# EAGLE schematic Resistor_Resistor (EAGLE 8.3.0), part 14 of 43
## Parts (continued)
R18758  10K  RESISTOR_0201  [0201]
R18759  10K  RESISTOR_0201  [0201]
R18760  10K  RESISTOR_0201  [0201]
R18761  10K  RESISTOR_0201  [0201]
R18762  10K  RESISTOR_0201  [0201]
R18763  10K  RESISTOR_0201  [0201]
R18764  10K  RESISTOR_0201  [0201]
R18765  10K  RESISTOR_0201  [0201]
R18766  10K  RESISTOR_0201  [0201]
R18767  10K  RESISTOR_0201  [0201]
R18768  10K  RESISTOR_0201  [0201]
R18769  10K  RESISTOR_0201  [0201]
R18770  10K  RESISTOR_0201  [0201]
R18771  10K  RESISTOR_0201  [0201]
R18772  10K  RESISTOR_0201  [0201]
R18773  10K  RESISTOR_0201  [0201]
R18774  10K  RESISTOR_0201  [0201]
R18775  10K  RESISTOR_0201  [0201]
R18776  10K  RESISTOR_0201  [0201]
R18777  10K  RESISTOR_0201  [0201]
R18778  10K  RESISTOR_0201  [0201]
R18779  10K  RESISTOR_0201  [0201]
R18780  10K  RESISTOR_0201  [0201]
R18781  10K  RESISTOR_0201  [0201]
R18782  10K  RESISTOR_0201  [0201]
R18783  10K  RESISTOR_0201  [0201]
R18784  10K  RESISTOR_0201  [0201]
R18785  10K  RESISTOR_0201  [0201]
R18786  10K  RESISTOR_0201  [0201]
R18787  10K  RESISTOR_0201  [0201]
R18788  10K  RESISTOR_0201  [0201]
R18789  10K  RESISTOR_0201  [0201]
R18790  10K  RESISTOR_0201  [0201]
R18791  10K  RESISTOR_0201  [0201]
R18792  10K  RESISTOR_0201  [0201]
R18793  10K  RESISTOR_0201  [0201]
R18794  10K  RESISTOR_0201  [0201]
R18795  10K  RESISTOR_0201  [0201]
R18796  10K  RESISTOR_0201  [0201]
R18797  10K  RESISTOR_0201  [0201]
R18798  10K  RESISTOR_0201  [0201]
R18799  10K  RESISTOR_0201  [0201]
R18800  10K  RESISTOR_0201  [0201]
R18801  10K  RESISTOR_0201  [0201]
R18802  10K  RESISTOR_0201  [0201]
R18803  10K  RESISTOR_0201  [0201]
R18804  10K  RESISTOR_0201  [0201]
R18805  10K  RESISTOR_0201  [0201]
R18806  10K  RESISTOR_0201  [0201]
R18807  10K  RESISTOR_0201  [0201]
R18808  10K  RESISTOR_0201  [0201]
R18809  10K  RESISTOR_0201  [0201]
R18810  10K  RESISTOR_0201  [0201]
R18811  10K  RESISTOR_0201  [0201]
R18812  10K  RESISTOR_0201  [0201]
R18813  10K  RESISTOR_0201  [0201]
R18814  10K  RESISTOR_0201  [0201]
R18815  10K  RESISTOR_0201  [0201]
R18816  10K  RESISTOR_0201  [0201]
R18817  10K  RESISTOR_0201  [0201]
R18818  10K  RESISTOR_0201  [0201]
R18819  10K  RESISTOR_0201  [0201]
R18820  10K  RESISTOR_0201  [0201]
R18821  10K  RESISTOR_0201  [0201]
R18822  10K  RESISTOR_0201  [0201]
R18823  10K  RESISTOR_0201  [0201]
R18824  10K  RESISTOR_0201  [0201]
R18825  10K  RESISTOR_0201  [0201]
R18826  10K  RESISTOR_0201  [0201]
R18827  10K  RESISTOR_0201  [0201]
R18828  10K  RESISTOR_0201  [0201]
R18829  10K  RESISTOR_0201  [0201]
R18830  10K  RESISTOR_0201  [0201]
R18831  10K  RESISTOR_0201  [0201]
R18832  10K  RESISTOR_0201  [0201]
R18833  10K  RESISTOR_0201  [0201]
R18834  10K  RESISTOR_0201  [0201]
R18835  10K  RESISTOR_0201  [0201]
R18836  10K  RESISTOR_0201  [0201]
R18837  10K  RESISTOR_0201  [0201]
R18838  10K  RESISTOR_0201  [0201]
R18839  10K  RESISTOR_0201  [0201]
R18840  10K  RESISTOR_0201  [0201]
R18841  10K  RESISTOR_0201  [0201]
R18842  10K  RESISTOR_0201  [0201]
R18843  10K  RESISTOR_0201  [0201]
R18844  10K  RESISTOR_0201  [0201]
R18845  10K  RESISTOR_0201  [0201]
R18846  10K  RESISTOR_0201  [0201]
R18847  10K  RESISTOR_0201  [0201]
R18848  10K  RESISTOR_0201  [0201]
R18849  10K  RESISTOR_0201  [0201]
R18850  10K  RESISTOR_0201  [0201]
R18851  10K  RESISTOR_0201  [0201]
R18852  10K  RESISTOR_0201  [0201]
R18853  10K  RESISTOR_0201  [0201]
R18854  10K  RESISTOR_0201  [0201]
R18855  10K  RESISTOR_0201  [0201]
R18856  10K  RESISTOR_0201  [0201]
R18857  10K  RESISTOR_0201  [0201]
R18858  10K  RESISTOR_0201  [0201]
R18859  10K  RESISTOR_0201  [0201]
R18860  10K  RESISTOR_0201  [0201]
R18861  10K  RESISTOR_0201  [0201]
R18862  10K  RESISTOR_0201  [0201]
R18863  10K  RESISTOR_0201  [0201]
R18864  10K  RESISTOR_0201  [0201]
R18865  10K  RESISTOR_0201  [0201]
R18866  10K  RESISTOR_0201  [0201]
R18867  10K  RESISTOR_0201  [0201]
R18868  10K  RESISTOR_0201  [0201]
R18869  10K  RESISTOR_0201  [0201]
R18870  10K  RESISTOR_0201  [0201]
R18871  10K  RESISTOR_0201  [0201]
R18872  10K  RESISTOR_0201  [0201]
R18873  10K  RESISTOR_0201  [0201]
R18874  10K  RESISTOR_0201  [0201]
R18875  10K  RESISTOR_0201  [0201]
R18876  10K  RESISTOR_0201  [0201]
R18877  10K  RESISTOR_0201  [0201]
R18878  10K  RESISTOR_0201  [0201]
R18879  10K  RESISTOR_0201  [0201]
R18880  10K  RESISTOR_0201  [0201]
R18881  10K  RESISTOR_0201  [0201]
R18882  10K  RESISTOR_0201  [0201]
R18883  10K  RESISTOR_0201  [0201]
R18884  10K  RESISTOR_0201  [0201]
R18885  10K  RESISTOR_0201  [0201]
R18886  10K  RESISTOR_0201  [0201]
R18887  10K  RESISTOR_0201  [0201]
R18888  10K  RESISTOR_0201  [0201]
R18889  10K  RESISTOR_0201  [0201]
R18890  10K  RESISTOR_0201  [0201]
R18891  10K  RESISTOR_0201  [0201]
R18892  10K  RESISTOR_0201  [0201]
R18893  10K  RESISTOR_0201  [0201]
R18894  10K  RESISTOR_0201  [0201]
R18895  10K  RESISTOR_0201  [0201]
R18896  10K  RESISTOR_0201  [0201]
R18897  10K  RESISTOR_0201  [0201]
R18898  10K  RESISTOR_0201  [0201]
R18899  10K  RESISTOR_0201  [0201]
R18900  10K  RESISTOR_0201  [0201]
R18901  10K  RESISTOR_0201  [0201]
R18902  10K  RESISTOR_0201  [0201]
R18903  10K  RESISTOR_0201  [0201]
R18904  10K  RESISTOR_0201  [0201]
R18905  10K  RESISTOR_0201  [0201]
R18906  10K  RESISTOR_0201  [0201]
R18907  10K  RESISTOR_0201  [0201]
R18908  10K  RESISTOR_0201  [0201]
R18909  10K  RESISTOR_0201  [0201]
R18910  10K  RESISTOR_0201  [0201]
R18911  10K  RESISTOR_0201  [0201]
R18912  10K  RESISTOR_0201  [0201]
R18913  10K  RESISTOR_0201  [0201]
R18914  10K  RESISTOR_0201  [0201]
R18915  10K  RESISTOR_0201  [0201]
R18916  10K  RESISTOR_0201  [0201]
R18917  10K  RESISTOR_0201  [0201]
R18918  10K  RESISTOR_0201  [0201]
R18919  10K  RESISTOR_0201  [0201]
R18920  10K  RESISTOR_0201  [0201]
R18921  10K  RESISTOR_0201  [0201]
R18922  10K  RESISTOR_0201  [0201]
R18923  10K  RESISTOR_0201  [0201]
R18924  10K  RESISTOR_0201  [0201]
R18925  10K  RESISTOR_0201  [0201]
R18926  10K  RESISTOR_0201  [0201]
R18927  10K  RESISTOR_0201  [0201]
R18928  10K  RESISTOR_0201  [0201]
R18929  10K  RESISTOR_0201  [0201]
R18930  10K  RESISTOR_0201  [0201]
R18931  10K  RESISTOR_0201  [0201]
R18932  10K  RESISTOR_0201  [0201]
R18933  10K  RESISTOR_0201  [0201]
R18934  10K  RESISTOR_0201  [0201]
R18935  10K  RESISTOR_0201  [0201]
R18936  10K  RESISTOR_0201  [0201]
R18937  10K  RESISTOR_0201  [0201]
R18938  10K  RESISTOR_0201  [0201]
R18939  10K  RESISTOR_0201  [0201]
R18940  10K  RESISTOR_0201  [0201]
R18941  10K  RESISTOR_0201  [0201]
R18942  10K  RESISTOR_0201  [0201]
R18943  10K  RESISTOR_0201  [0201]
R18944  10K  RESISTOR_0201  [0201]
R18945  10K  RESISTOR_0201  [0201]
R18946  10K  RESISTOR_0201  [0201]
R18947  10K  RESISTOR_0201  [0201]
R18948  10K  RESISTOR_0201  [0201]
R18949  10K  RESISTOR_0201  [0201]
R18950  10K  RESISTOR_0201  [0201]
R18951  10K  RESISTOR_0201  [0201]
R18952  10K  RESISTOR_0201  [0201]
R18953  10K  RESISTOR_0201  [0201]
R18954  10K  RESISTOR_0201  [0201]
R18955  10K  RESISTOR_0201  [0201]
R18956  10K  RESISTOR_0201  [0201]
R18957  10K  RESISTOR_0201  [0201]
R18958  10K  RESISTOR_0201  [0201]
R18959  10K  RESISTOR_0201  [0201]
R18960  10K  RESISTOR_0201  [0201]
R18961  10K  RESISTOR_0201  [0201]
R18962  10K  RESISTOR_0201  [0201]
R18963  10K  RESISTOR_0201  [0201]
R18964  10K  RESISTOR_0201  [0201]
R18965  10K  RESISTOR_0201  [0201]
R18966  10K  RESISTOR_0201  [0201]
R18967  10K  RESISTOR_0201  [0201]
R18968  10K  RESISTOR_0201  [0201]
R18969  10K  RESISTOR_0201  [0201]
R18970  10K  RESISTOR_0201  [0201]
R18971  10K  RESISTOR_0201  [0201]
R18972  10K  RESISTOR_0201  [0201]
R18973  10K  RESISTOR_0201  [0201]
R18974  10K  RESISTOR_0201  [0201]
R18975  10K  RESISTOR_0201  [0201]
R18976  10K  RESISTOR_0201  [0201]
R18977  10K  RESISTOR_0201  [0201]
R18978  10K  RESISTOR_0201  [0201]
R18979  10K  RESISTOR_0201  [0201]
R18980  10K  RESISTOR_0201  [0201]
R18981  10K  RESISTOR_0201  [0201]
R18982  10K  RESISTOR_0201  [0201]
R18983  10K  RESISTOR_0201  [0201]
R18984  10K  RESISTOR_0201  [0201]
R18985  10K  RESISTOR_0201  [0201]
R18986  10K  RESISTOR_0201  [0201]
R18987  10K  RESISTOR_0201  [0201]
R18988  10K  RESISTOR_0201  [0201]
R18989  10K  RESISTOR_0201  [0201]
R18990  10K  RESISTOR_0201  [0201]
R18991  10K  RESISTOR_0201  [0201]
R18992  10K  RESISTOR_0201  [0201]
R18993  10K  RESISTOR_0201  [0201]
R18994  10K  RESISTOR_0201  [0201]
R18995  10K  RESISTOR_0201  [0201]
R18996  10K  RESISTOR_0201  [0201]
R18997  10K  RESISTOR_0201  [0201]
R18998  10K  RESISTOR_0201  [0201]
R18999  10K  RESISTOR_0201  [0201]
R19000  10K  RESISTOR_0201  [0201]
R19001  10K  RESISTOR_0201  [0201]
R19002  10K  RESISTOR_0201  [0201]
R19003  10K  RESISTOR_0201  [0201]
R19004  10K  RESISTOR_0201  [0201]
R19005  10K  RESISTOR_0201  [0201]
R19006  10K  RESISTOR_0201  [0201]
R19007  10K  RESISTOR_0201  [0201]
R19008  10K  RESISTOR_0201  [0201]
R19009  10K  RESISTOR_0201  [0201]
R19010  10K  RESISTOR_0201  [0201]
R19011  10K  RESISTOR_0201  [0201]
R19012  10K  RESISTOR_0201  [0201]
R19013  10K  RESISTOR_0201  [0201]
R19014  10K  RESISTOR_0201  [0201]
R19015  10K  RESISTOR_0201  [0201]
R19016  10K  RESISTOR_0201  [0201]
R19017  10K  RESISTOR_0201  [0201]
R19018  10K  RESISTOR_0201  [0201]
R19019  10K  RESISTOR_0201  [0201]
R19020  10K  RESISTOR_0201  [0201]
R19021  10K  RESISTOR_0201  [0201]
R19022  10K  RESISTOR_0201  [0201]
R19023  10K  RESISTOR_0201  [0201]
R19024  10K  RESISTOR_0201  [0201]
R19025  10K  RESISTOR_0201  [0201]
R19026  10K  RESISTOR_0201  [0201]
R19027  10K  RESISTOR_0201  [0201]
R19028  10K  RESISTOR_0201  [0201]
R19029  10K  RESISTOR_0201  [0201]
R19030  10K  RESISTOR_0201  [0201]
R19031  10K  RESISTOR_0201  [0201]
R19032  10K  RESISTOR_0201  [0201]
R19033  10K  RESISTOR_0201  [0201]
R19034  10K  RESISTOR_0201  [0201]
R19035  10K  RESISTOR_0201  [0201]
R19036  10K  RESISTOR_0201  [0201]
R19037  10K  RESISTOR_0201  [0201]
R19038  10K  RESISTOR_0201  [0201]
R19039  10K  RESISTOR_0201  [0201]
R19040  10K  RESISTOR_0201  [0201]
R19041  10K  RESISTOR_0201  [0201]
R19042  10K  RESISTOR_0201  [0201]
R19043  10K  RESISTOR_0201  [0201]
R19044  10K  RESISTOR_0201  [0201]
R19045  10K  RESISTOR_0201  [0201]
R19046  10K  RESISTOR_0201  [0201]
R19047  10K  RESISTOR_0201  [0201]
R19048  10K  RESISTOR_0201  [0201]
R19049  10K  RESISTOR_0201  [0201]
R19050  10K  RESISTOR_0201  [0201]
R19051  10K  RESISTOR_0201  [0201]
R19052  10K  RESISTOR_0201  [0201]
R19053  10K  RESISTOR_0201  [0201]
R19054  10K  RESISTOR_0201  [0201]
R19055  10K  RESISTOR_0201  [0201]
R19056  10K  RESISTOR_0201  [0201]
R19057  10K  RESISTOR_0201  [0201]
R19058  10K  RESISTOR_0201  [0201]
R19059  10K  RESISTOR_0201  [0201]
R19060  10K  RESISTOR_0201  [0201]
R19061  10K  RESISTOR_0201  [0201]
R19062  10K  RESISTOR_0201  [0201]
R19063  10K  RESISTOR_0201  [0201]
R19064  10K  RESISTOR_0201  [0201]
R19065  10K  RESISTOR_0201  [0201]
R19066  10K  RESISTOR_0201  [0201]
R19067  10K  RESISTOR_0201  [0201]
R19068  10K  RESISTOR_0201  [0201]
R19069  10K  RESISTOR_0201  [0201]
R19070  10K  RESISTOR_0201  [0201]
R19071  10K  RESISTOR_0201  [0201]
R19072  10K  RESISTOR_0201  [0201]
R19073  10K  RESISTOR_0201  [0201]
R19074  10K  RESISTOR_0201  [0201]
R19075  10K  RESISTOR_0201  [0201]
R19076  10K  RESISTOR_0201  [0201]
R19077  10K  RESISTOR_0201  [0201]
R19078  10K  RESISTOR_0201  [0201]
R19079  10K  RESISTOR_0201  [0201]
R19080  10K  RESISTOR_0201  [0201]
R19081  10K  RESISTOR_0201  [0201]
R19082  10K  RESISTOR_0201  [0201]
R19083  10K  RESISTOR_0201  [0201]
R19084  10K  RESISTOR_0201  [0201]
R19085  10K  RESISTOR_0201  [0201]
R19086  10K  RESISTOR_0201  [0201]
R19087  10K  RESISTOR_0201  [0201]
R19088  10K  RESISTOR_0201  [0201]
R19089  10K  RESISTOR_0201  [0201]
R19090  10K  RESISTOR_0201  [0201]
R19091  10K  RESISTOR_0201  [0201]
R19092  10K  RESISTOR_0201  [0201]
R19093  10K  RESISTOR_0201  [0201]
R19094  10K  RESISTOR_0201  [0201]
R19095  10K  RESISTOR_0201  [0201]
R19096  10K  RESISTOR_0201  [0201]
R19097  10K  RESISTOR_0201  [0201]
R19098  10K  RESISTOR_0201  [0201]
R19099  10K  RESISTOR_0201  [0201]
R19100  10K  RESISTOR_0201  [0201]
R19101  10K  RESISTOR_0201  [0201]
R19102  10K  RESISTOR_0201  [0201]
R19103  10K  RESISTOR_0201  [0201]
R19104  10K  RESISTOR_0201  [0201]
R19105  10K  RESISTOR_0201  [0201]
R19106  10K  RESISTOR_0201  [0201]
R19107  10K  RESISTOR_0201  [0201]
R19108  10K  RESISTOR_0201  [0201]
R19109  10K  RESISTOR_0201  [0201]
R19110  10K  RESISTOR_0201  [0201]
R19111  10K  RESISTOR_0201  [0201]
R19112  10K  RESISTOR_0201  [0201]
R19113  10K  RESISTOR_0201  [0201]
R19114  10K  RESISTOR_0201  [0201]
R19115  10K  RESISTOR_0201  [0201]
R19116  10K  RESISTOR_0201  [0201]
R19117  10K  RESISTOR_0201  [0201]
R19118  10K  RESISTOR_0201  [0201]
R19119  10K  RESISTOR_0201  [0201]
R19120  10K  RESISTOR_0201  [0201]
R19121  10K  RESISTOR_0201  [0201]
R19122  10K  RESISTOR_0201  [0201]
R19123  10K  RESISTOR_0201  [0201]
R19124  10K  RESISTOR_0201  [0201]
R19125  10K  RESISTOR_0201  [0201]
R19126  10K  RESISTOR_0201  [0201]
R19127  10K  RESISTOR_0201  [0201]
R19128  10K  RESISTOR_0201  [0201]
R19129  10K  RESISTOR_0201  [0201]
R19130  10K  RESISTOR_0201  [0201]
R19131  10K  RESISTOR_0201  [0201]
R19132  10K  RESISTOR_0201  [0201]
R19133  10K  RESISTOR_0201  [0201]
R19134  10K  RESISTOR_0201  [0201]
R19135  10K  RESISTOR_0201  [0201]
R19136  10K  RESISTOR_0201  [0201]
R19137  10K  RESISTOR_0201  [0201]
R19138  10K  RESISTOR_0201  [0201]
R19139  10K  RESISTOR_0201  [0201]
R19140  10K  RESISTOR_0201  [0201]
R19141  10K  RESISTOR_0201  [0201]
R19142  10K  RESISTOR_0201  [0201]
R19143  10K  RESISTOR_0201  [0201]
R19144  10K  RESISTOR_0201  [0201]
R19145  10K  RESISTOR_0201  [0201]
R19146  10K  RESISTOR_0201  [0201]
R19147  10K  RESISTOR_0201  [0201]
R19148  10K  RESISTOR_0201  [0201]
R19149  10K  RESISTOR_0201  [0201]
R19150  10K  RESISTOR_0201  [0201]
R19151  10K  RESISTOR_0201  [0201]
R19152  10K  RESISTOR_0201  [0201]
R19153  10K  RESISTOR_0201  [0201]
R19154  10K  RESISTOR_0201  [0201]
R19155  10K  RESISTOR_0201  [0201]
R19156  10K  RESISTOR_0201  [0201]
R19157  10K  RESISTOR_0201  [0201]
R19158  10K  RESISTOR_0201  [0201]
R19159  10K  RESISTOR_0201  [0201]
R19160  10K  RESISTOR_0201  [0201]
R19161  10K  RESISTOR_0201  [0201]
R19162  10K  RESISTOR_0201  [0201]
R19163  10K  RESISTOR_0201  [0201]
R19164  10K  RESISTOR_0201  [0201]
R19165  10K  RESISTOR_0201  [0201]
R19166  10K  RESISTOR_0201  [0201]
R19167  10K  RESISTOR_0201  [0201]
R19168  10K  RESISTOR_0201  [0201]
R19169  10K  RESISTOR_0201  [0201]
R19170  10K  RESISTOR_0201  [0201]
R19171  10K  RESISTOR_0201  [0201]
R19172  10K  RESISTOR_0201  [0201]
R19173  10K  RESISTOR_0201  [0201]
R19174  10K  RESISTOR_0201  [0201]
R19175  10K  RESISTOR_0201  [0201]
R19176  10K  RESISTOR_0201  [0201]
R19177  10K  RESISTOR_0201  [0201]
R19178  10K  RESISTOR_0201  [0201]
R19179  10K  RESISTOR_0201  [0201]
R19180  10K  RESISTOR_0201  [0201]
R19181  10K  RESISTOR_0201  [0201]
R19182  10K  RESISTOR_0201  [0201]
R19183  10K  RESISTOR_0201  [0201]
R19184  10K  RESISTOR_0201  [0201]
R19185  10K  RESISTOR_0201  [0201]
R19186  10K  RESISTOR_0201  [0201]
R19187  10K  RESISTOR_0201  [0201]
R19188  10K  RESISTOR_0201  [0201]
R19189  10K  RESISTOR_0201  [0201]
R19190  10K  RESISTOR_0201  [0201]
R19191  10K  RESISTOR_0201  [0201]
R19192  10K  RESISTOR_0201  [0201]
R19193  10K  RESISTOR_0201  [0201]
R19194  10K  RESISTOR_0201  [0201]
R19195  10K  RESISTOR_0201  [0201]
R19196  10K  RESISTOR_0201  [0201]
R19197  10K  RESISTOR_0201  [0201]
R19198  10K  RESISTOR_0201  [0201]
R19199  10K  RESISTOR_0201  [0201]
R19200  10K  RESISTOR_0201  [0201]
R19201  10K  RESISTOR_0201  [0201]
R19202  10K  RESISTOR_0201  [0201]
R19203  10K  RESISTOR_0201  [0201]
R19204  10K  RESISTOR_0201  [0201]
R19205  10K  RESISTOR_0201  [0201]
R19206  10K  RESISTOR_0201  [0201]
R19207  10K  RESISTOR_0201  [0201]
R19208  10K  RESISTOR_0201  [0201]
R19209  10K  RESISTOR_0201  [0201]
R19210  10K  RESISTOR_0201  [0201]
R19211  10K  RESISTOR_0201  [0201]
R19212  10K  RESISTOR_0201  [0201]
R19213  10K  RESISTOR_0201  [0201]
R19214  10K  RESISTOR_0201  [0201]
R19215  10K  RESISTOR_0201  [0201]
R19216  10K  RESISTOR_0201  [0201]
R19217  10K  RESISTOR_0201  [0201]
R19218  10K  RESISTOR_0201  [0201]
R19219  10K  RESISTOR_0201  [0201]
R19220  10K  RESISTOR_0201  [0201]
R19221  10K  RESISTOR_0201  [0201]
R19222  10K  RESISTOR_0201  [0201]
R19223  10K  RESISTOR_0201  [0201]
R19224  10K  RESISTOR_0201  [0201]
R19225  10K  RESISTOR_0201  [0201]
R19226  10K  RESISTOR_0201  [0201]
R19227  10K  RESISTOR_0201  [0201]
R19228  10K  RESISTOR_0201  [0201]
R19229  10K  RESISTOR_0201  [0201]
R19230  10K  RESISTOR_0201  [0201]
R19231  10K  RESISTOR_0201  [0201]
R19232  10K  RESISTOR_0201  [0201]
R19233  10K  RESISTOR_0201  [0201]
R19234  10K  RESISTOR_0201  [0201]
R19235  10K  RESISTOR_0201  [0201]
R19236  10K  RESISTOR_0201  [0201]
R19237  10K  RESISTOR_0201  [0201]
R19238  10K  RESISTOR_0201  [0201]
R19239  10K  RESISTOR_0201  [0201]
R19240  10K  RESISTOR_0201  [0201]
R19241  10K  RESISTOR_0201  [0201]
R19242  10K  RESISTOR_0201  [0201]
R19243  10K  RESISTOR_0201  [0201]
R19244  10K  RESISTOR_0201  [0201]
R19245  10K  RESISTOR_0201  [0201]
R19246  10K  RESISTOR_0201  [0201]
R19247  10K  RESISTOR_0201  [0201]
R19248  10K  RESISTOR_0201  [0201]
R19249  10K  RESISTOR_0201  [0201]
R19250  10K  RESISTOR_0201  [0201]
R19251  10K  RESISTOR_0201  [0201]
R19252  10K  RESISTOR_0201  [0201]
R19253  10K  RESISTOR_0201  [0201]
R19254  10K  RESISTOR_0201  [0201]
R19255  10K  RESISTOR_0201  [0201]
R19256  10K  RESISTOR_0201  [0201]
R19257  10K  RESISTOR_0201  [0201]
R19258  10K  RESISTOR_0201  [0201]
R19259  10K  RESISTOR_0201  [0201]
R19260  10K  RESISTOR_0201  [0201]
R19261  10K  RESISTOR_0201  [0201]
R19262  10K  RESISTOR_0201  [0201]
R19263  10K  RESISTOR_0201  [0201]
R19264  10K  RESISTOR_0201  [0201]
R19265  10K  RESISTOR_0201  [0201]
R19266  10K  RESISTOR_0201  [0201]
R19267  10K  RESISTOR_0201  [0201]
R19268  10K  RESISTOR_0201  [0201]
R19269  10K  RESISTOR_0201  [0201]
R19270  10K  RESISTOR_0201  [0201]
R19271  10K  RESISTOR_0201  [0201]
R19272  10K  RESISTOR_0201  [0201]
R19273  10K  RESISTOR_0201  [0201]
R19274  10K  RESISTOR_0201  [0201]
R19275  10K  RESISTOR_0201  [0201]
R19276  10K  RESISTOR_0201  [0201]
R19277  10K  RESISTOR_0201  [0201]
R19278  10K  RESISTOR_0201  [0201]
R19279  10K  RESISTOR_0201  [0201]
R19280  10K  RESISTOR_0201  [0201]
R19281  10K  RESISTOR_0201  [0201]
R19282  10K  RESISTOR_0201  [0201]
R19283  10K  RESISTOR_0201  [0201]
R19284  10K  RESISTOR_0201  [0201]
R19285  10K  RESISTOR_0201  [0201]
R19286  10K  RESISTOR_0201  [0201]
R19287  10K  RESISTOR_0201  [0201]
R19288  10K  RESISTOR_0201  [0201]
R19289  10K  RESISTOR_0201  [0201]
R19290  10K  RESISTOR_0201  [0201]
R19291  10K  RESISTOR_0201  [0201]
R19292  10K  RESISTOR_0201  [0201]
R19293  10K  RESISTOR_0201  [0201]
R19294  10K  RESISTOR_0201  [0201]
R19295  10K  RESISTOR_0201  [0201]
R19296  10K  RESISTOR_0201  [0201]
R19297  10K  RESISTOR_0201  [0201]
R19298  10K  RESISTOR_0201  [0201]
R19299  10K  RESISTOR_0201  [0201]
R19300  10K  RESISTOR_0201  [0201]
R19301  10K  RESISTOR_0201  [0201]
R19302  10K  RESISTOR_0201  [0201]
R19303  10K  RESISTOR_0201  [0201]
R19304  10K  RESISTOR_0201  [0201]
R19305  10K  RESISTOR_0201  [0201]
R19306  10K  RESISTOR_0201  [0201]
R19307  10K  RESISTOR_0201  [0201]
R19308  10K  RESISTOR_0201  [0201]
R19309  10K  RESISTOR_0201  [0201]
R19310  10K  RESISTOR_0201  [0201]
R19311  10K  RESISTOR_0201  [0201]
R19312  10K  RESISTOR_0201  [0201]
R19313  10K  RESISTOR_0201  [0201]
R19314  10K  RESISTOR_0201  [0201]
R19315  10K  RESISTOR_0201  [0201]
R19316  10K  RESISTOR_0201  [0201]
R19317  10K  RESISTOR_0201  [0201]
R19318  10K  RESISTOR_0201  [0201]
R19319  10K  RESISTOR_0201  [0201]
R19320  10K  RESISTOR_0201  [0201]
R19321  10K  RESISTOR_0201  [0201]
R19322  10K  RESISTOR_0201  [0201]
R19323  10K  RESISTOR_0201  [0201]
R19324  10K  RESISTOR_0201  [0201]
R19325  10K  RESISTOR_0201  [0201]
R19326  10K  RESISTOR_0201  [0201]
R19327  10K  RESISTOR_0201  [0201]
R19328  10K  RESISTOR_0201  [0201]
R19329  10K  RESISTOR_0201  [0201]
R19330  10K  RESISTOR_0201  [0201]
R19331  10K  RESISTOR_0201  [0201]
R19332  10K  RESISTOR_0201  [0201]
R19333  10K  RESISTOR_0201  [0201]
R19334  10K  RESISTOR_0201  [0201]
R19335  10K  RESISTOR_0201  [0201]
R19336  10K  RESISTOR_0201  [0201]
R19337  10K  RESISTOR_0201  [0201]
R19338  10K  RESISTOR_0201  [0201]
R19339  10K  RESISTOR_0201  [0201]
R19340  10K  RESISTOR_0201  [0201]
R19341  10K  RESISTOR_0201  [0201]
R19342  10K  RESISTOR_0201  [0201]
R19343  10K  RESISTOR_0201  [0201]
R19344  10K  RESISTOR_0201  [0201]
R19345  10K  RESISTOR_0201  [0201]
R19346  10K  RESISTOR_0201  [0201]
R19347  10K  RESISTOR_0201  [0201]
R19348  10K  RESISTOR_0201  [0201]
R19349  10K  RESISTOR_0201  [0201]
R19350  10K  RESISTOR_0201  [0201]
R19351  10K  RESISTOR_0201  [0201]
R19352  10K  RESISTOR_0201  [0201]
R19353  10K  RESISTOR_0201  [0201]
R19354  10K  RESISTOR_0201  [0201]
R19355  10K  RESISTOR_0201  [0201]
R19356  10K  RESISTOR_0201  [0201]
R19357  10K  RESISTOR_0201  [0201]
R19358  10K  RESISTOR_0201  [0201]
R19359  10K  RESISTOR_0201  [0201]
R19360  10K  RESISTOR_0201  [0201]
R19361  10K  RESISTOR_0201  [0201]
R19362  10K  RESISTOR_0201  [0201]
R19363  10K  RESISTOR_0201  [0201]
R19364  10K  RESISTOR_0201  [0201]
R19365  10K  RESISTOR_0201  [0201]
R19366  10K  RESISTOR_0201  [0201]
R19367  10K  RESISTOR_0201  [0201]
R19368  10K  RESISTOR_0201  [0201]
R19369  10K  RESISTOR_0201  [0201]
R19370  10K  RESISTOR_0201  [0201]
R19371  10K  RESISTOR_0201  [0201]
R19372  10K  RESISTOR_0201  [0201]
R19373  10K  RESISTOR_0201  [0201]
R19374  10K  RESISTOR_0201  [0201]
R19375  10K  RESISTOR_0201  [0201]
R19376  10K  RESISTOR_0201  [0201]
R19377  10K  RESISTOR_0201  [0201]
R19378  10K  RESISTOR_0201  [0201]
R19379  10K  RESISTOR_0201  [0201]
R19380  10K  RESISTOR_0201  [0201]
R19381  10K  RESISTOR_0201  [0201]
R19382  10K  RESISTOR_0201  [0201]
R19383  10K  RESISTOR_0201  [0201]
R19384  10K  RESISTOR_0201  [0201]
R19385  10K  RESISTOR_0201  [0201]
R19386  10K  RESISTOR_0201  [0201]
R19387  10K  RESISTOR_0201  [0201]
R19388  10K  RESISTOR_0201  [0201]
R19389  10K  RESISTOR_0201  [0201]
R19390  10K  RESISTOR_0201  [0201]
R19391  10K  RESISTOR_0201  [0201]
R19392  10K  RESISTOR_0201  [0201]
R19393  10K  RESISTOR_0201  [0201]
R19394  10K  RESISTOR_0201  [0201]
R19395  10K  RESISTOR_0201  [0201]
R19396  10K  RESISTOR_0201  [0201]
R19397  10K  RESISTOR_0201  [0201]
R19398  10K  RESISTOR_0201  [0201]
R19399  10K  RESISTOR_0201  [0201]
R19400  10K  RESISTOR_0201  [0201]
R19401  10K  RESISTOR_0201  [0201]
R19402  10K  RESISTOR_0201  [0201]
R19403  10K  RESISTOR_0201  [0201]
R19404  10K  RESISTOR_0201  [0201]
R19405  10K  RESISTOR_0201  [0201]
R19406  10K  RESISTOR_0201  [0201]
R19407  10K  RESISTOR_0201  [0201]
R19408  10K  RESISTOR_0201  [0201]
R19409  10K  RESISTOR_0201  [0201]
R19410  10K  RESISTOR_0201  [0201]
R19411  10K  RESISTOR_0201  [0201]
R19412  10K  RESISTOR_0201  [0201]
R19413  10K  RESISTOR_0201  [0201]
R19414  10K  RESISTOR_0201  [0201]
R19415  10K  RESISTOR_0201  [0201]
R19416  10K  RESISTOR_0201  [0201]
R19417  10K  RESISTOR_0201  [0201]
R19418  10K  RESISTOR_0201  [0201]
R19419  10K  RESISTOR_0201  [0201]
R19420  10K  RESISTOR_0201  [0201]
R19421  10K  RESISTOR_0201  [0201]
R19422  10K  RESISTOR_0201  [0201]
R19423  10K  RESISTOR_0201  [0201]
R19424  10K  RESISTOR_0201  [0201]
R19425  10K  RESISTOR_0201  [0201]
R19426  10K  RESISTOR_0201  [0201]
R19427  10K  RESISTOR_0201  [0201]
R19428  10K  RESISTOR_0201  [0201]
R19429  10K  RESISTOR_0201  [0201]
R19430  10K  RESISTOR_0201  [0201]
R19431  10K  RESISTOR_0201  [0201]
R19432  10K  RESISTOR_0201  [0201]
R19433  10K  RESISTOR_0201  [0201]
R19434  10K  RESISTOR_0201  [0201]
R19435  10K  RESISTOR_0201  [0201]
R19436  10K  RESISTOR_0201  [0201]
R19437  10K  RESISTOR_0201  [0201]
R19438  10K  RESISTOR_0201  [0201]
R19439  10K  RESISTOR_0201  [0201]
R19440  10K  RESISTOR_0201  [0201]
R19441  10K  RESISTOR_0201  [0201]
R19442  10K  RESISTOR_0201  [0201]
R19443  10K  RESISTOR_0201  [0201]
R19444  10K  RESISTOR_0201  [0201]
R19445  10K  RESISTOR_0201  [0201]
R19446  10K  RESISTOR_0201  [0201]
R19447  10K  RESISTOR_0201  [0201]
R19448  10K  RESISTOR_0201  [0201]
R19449  10K  RESISTOR_0201  [0201]
R19450  10K  RESISTOR_0201  [0201]
R19451  10K  RESISTOR_0201  [0201]
R19452  10K  RESISTOR_0201  [0201]
R19453  10K  RESISTOR_0201  [0201]
R19454  10K  RESISTOR_0201  [0201]
R19455  10K  RESISTOR_0201  [0201]
R19456  10K  RESISTOR_0201  [0201]
R19457  10K  RESISTOR_0201  [0201]
R19458  10K  RESISTOR_0201  [0201]
R19459  10K  RESISTOR_0201  [0201]
R19460  10K  RESISTOR_0201  [0201]
R19461  10K  RESISTOR_0201  [0201]
R19462  10K  RESISTOR_0201  [0201]
R19463  10K  RESISTOR_0201  [0201]
R19464  10K  RESISTOR_0201  [0201]
R19465  10K  RESISTOR_0201  [0201]
R19466  10K  RESISTOR_0201  [0201]
R19467  10K  RESISTOR_0201  [0201]
R19468  10K  RESISTOR_0201  [0201]
R19469  10K  RESISTOR_0201  [0201]
R19470  10K  RESISTOR_0201  [0201]
R19471  10K  RESISTOR_0201  [0201]
R19472  10K  RESISTOR_0201  [0201]
R19473  10K  RESISTOR_0201  [0201]
R19474  10K  RESISTOR_0201  [0201]
R19475  10K  RESISTOR_0201  [0201]
R19476  10K  RESISTOR_0201  [0201]
R19477  10K  RESISTOR_0201  [0201]
R19478  10K  RESISTOR_0201  [0201]
R19479  10K  RESISTOR_0201  [0201]
R19480  10K  RESISTOR_0201  [0201]
R19481  10K  RESISTOR_0201  [0201]
R19482  10K  RESISTOR_0201  [0201]
R19483  10K  RESISTOR_0201  [0201]
R19484  10K  RESISTOR_0201  [0201]
R19485  10K  RESISTOR_0201  [0201]
R19486  10K  RESISTOR_0201  [0201]
R19487  10K  RESISTOR_0201  [0201]
R19488  10K  RESISTOR_0201  [0201]
R19489  10K  RESISTOR_0201  [0201]
R19490  10K  RESISTOR_0201  [0201]
R19491  10K  RESISTOR_0201  [0201]
R19492  10K  RESISTOR_0201  [0201]
R19493  10K  RESISTOR_0201  [0201]
R19494  10K  RESISTOR_0201  [0201]
R19495  10K  RESISTOR_0201  [0201]
R19496  10K  RESISTOR_0201  [0201]
R19497  10K  RESISTOR_0201  [0201]
R19498  10K  RESISTOR_0201  [0201]
R19499  10K  RESISTOR_0201  [0201]
R19500  10K  RESISTOR_0201  [0201]
R19501  10K  RESISTOR_0201  [0201]
R19502  10K  RESISTOR_0201  [0201]
R19503  10K  RESISTOR_0201  [0201]
R19504  10K  RESISTOR_0201  [0201]
R19505  10K  RESISTOR_0201  [0201]
R19506  10K  RESISTOR_0201  [0201]
R19507  10K  RESISTOR_0201  [0201]
R19508  10K  RESISTOR_0201  [0201]
R19509  10K  RESISTOR_0201  [0201]
R19510  10K  RESISTOR_0201  [0201]
R19511  10K  RESISTOR_0201  [0201]
R19512  10K  RESISTOR_0201  [0201]
R19513  10K  RESISTOR_0201  [0201]
R19514  10K  RESISTOR_0201  [0201]
R19515  10K  RESISTOR_0201  [0201]
R19516  10K  RESISTOR_0201  [0201]
R19517  10K  RESISTOR_0201  [0201]
R19518  10K  RESISTOR_0201  [0201]
R19519  10K  RESISTOR_0201  [0201]
R19520  10K  RESISTOR_0201  [0201]
R19521  10K  RESISTOR_0201  [0201]
R19522  10K  RESISTOR_0201  [0201]
R19523  10K  RESISTOR_0201  [0201]
R19524  10K  RESISTOR_0201  [0201]
R19525  10K  RESISTOR_0201  [0201]
R19526  10K  RESISTOR_0201  [0201]
R19527  10K  RESISTOR_0201  [0201]
R19528  10K  RESISTOR_0201  [0201]
R19529  10K  RESISTOR_0201  [0201]
R19530  10K  RESISTOR_0201  [0201]
R19531  10K  RESISTOR_0201  [0201]
R19532  10K  RESISTOR_0201  [0201]
R19533  10K  RESISTOR_0201  [0201]
R19534  10K  RESISTOR_0201  [0201]
R19535  10K  RESISTOR_0201  [0201]
R19536  10K  RESISTOR_0201  [0201]
R19537  10K  RESISTOR_0201  [0201]
R19538  10K  RESISTOR_0201  [0201]
R19539  10K  RESISTOR_0201  [0201]
R19540  10K  RESISTOR_0201  [0201]
R19541  10K  RESISTOR_0201  [0201]
R19542  10K  RESISTOR_0201  [0201]
R19543  10K  RESISTOR_0201  [0201]
R19544  10K  RESISTOR_0201  [0201]
R19545  10K  RESISTOR_0201  [0201]
R19546  10K  RESISTOR_0201  [0201]
R19547  10K  RESISTOR_0201  [0201]
R19548  10K  RESISTOR_0201  [0201]
R19549  10K  RESISTOR_0201  [0201]
R19550  10K  RESISTOR_0201  [0201]
R19551  10K  RESISTOR_0201  [0201]
R19552  10K  RESISTOR_0201  [0201]
R19553  10K  RESISTOR_0201  [0201]
R19554  10K  RESISTOR_0201  [0201]
R19555  10K  RESISTOR_0201  [0201]
R19556  10K  RESISTOR_0201  [0201]
R19557  10K  RESISTOR_0201  [0201]
R19558  10K  RESISTOR_0201  [0201]
R19559  10K  RESISTOR_0201  [0201]
R19560  10K  RESISTOR_0201  [0201]
R19561  10K  RESISTOR_0201  [0201]
R19562  10K  RESISTOR_0201  [0201]
R19563  10K  RESISTOR_0201  [0201]
R19564  10K  RESISTOR_0201  [0201]
R19565  10K  RESISTOR_0201  [0201]
R19566  10K  RESISTOR_0201  [0201]
R19567  10K  RESISTOR_0201  [0201]
R19568  10K  RESISTOR_0201  [0201]
R19569  10K  RESISTOR_0201  [0201]
R19570  10K  RESISTOR_0201  [0201]
R19571  10K  RESISTOR_0201  [0201]
R19572  10K  RESISTOR_0201  [0201]
R19573  10K  RESISTOR_0201  [0201]
R19574  10K  RESISTOR_0201  [0201]
R19575  10K  RESISTOR_0201  [0201]
R19576  10K  RESISTOR_0201  [0201]
R19577  10K  RESISTOR_0201  [0201]
R19578  10K  RESISTOR_0201  [0201]
R19579  10K  RESISTOR_0201  [0201]
R19580  10K  RESISTOR_0201  [0201]
R19581  10K  RESISTOR_0201  [0201]
R19582  10K  RESISTOR_0201  [0201]
R19583  10K  RESISTOR_0201  [0201]
R19584  10K  RESISTOR_0201  [0201]
R19585  10K  RESISTOR_0201  [0201]
R19586  10K  RESISTOR_0201  [0201]
R19587  10K  RESISTOR_0201  [0201]
R19588  10K  RESISTOR_0201  [0201]
R19589  10K  RESISTOR_0201  [0201]
R19590  10K  RESISTOR_0201  [0201]
R19591  10K  RESISTOR_0201  [0201]
R19592  10K  RESISTOR_0201  [0201]
R19593  10K  RESISTOR_0201  [0201]
R19594  10K  RESISTOR_0201  [0201]
R19595  10K  RESISTOR_0201  [0201]
R19596  10K  RESISTOR_0201  [0201]
R19597  10K  RESISTOR_0201  [0201]
R19598  10K  RESISTOR_0201  [0201]
R19599  10K  RESISTOR_0201  [0201]
R19600  10K  RESISTOR_0201  [0201]
R19601  10K  RESISTOR_0201  [0201]
R19602  10K  RESISTOR_0201  [0201]
R19603  10K  RESISTOR_0201  [0201]
R19604  10K  RESISTOR_0201  [0201]
R19605  10K  RESISTOR_0201  [0201]
R19606  10K  RESISTOR_0201  [0201]
R19607  10K  RESISTOR_0201  [0201]
R19608  10K  RESISTOR_0201  [0201]
R19609  10K  RESISTOR_0201  [0201]
R19610  10K  RESISTOR_0201  [0201]
R19611  10K  RESISTOR_0201  [0201]
R19612  10K  RESISTOR_0201  [0201]
R19613  10K  RESISTOR_0201  [0201]
R19614  10K  RESISTOR_0201  [0201]
R19615  10K  RESISTOR_0201  [0201]
R19616  10K  RESISTOR_0201  [0201]
R19617  10K  RESISTOR_0201  [0201]
R19618  10K  RESISTOR_0201  [0201]
R19619  10K  RESISTOR_0201  [0201]
R19620  10K  RESISTOR_0201  [0201]
R19621  10K  RESISTOR_0201  [0201]
R19622  10K  RESISTOR_0201  [0201]
R19623  10K  RESISTOR_0201  [0201]
R19624  10K  RESISTOR_0201  [0201]
R19625  10K  RESISTOR_0201  [0201]
R19626  10K  RESISTOR_0201  [0201]
R19627  10K  RESISTOR_0201  [0201]
R19628  10K  RESISTOR_0201  [0201]
R19629  10K  RESISTOR_0201  [0201]
R19630  10K  RESISTOR_0201  [0201]
R19631  10K  RESISTOR_0201  [0201]
R19632  10K  RESISTOR_0201  [0201]
R19633  10K  RESISTOR_0201  [0201]
R19634  10K  RESISTOR_0201  [0201]
R19635  10K  RESISTOR_0201  [0201]
R19636  10K  RESISTOR_0201  [0201]
R19637  10K  RESISTOR_0201  [0201]
R19638  10K  RESISTOR_0201  [0201]
R19639  10K  RESISTOR_0201  [0201]
R19640  10K  RESISTOR_0201  [0201]
R19641  10K  RESISTOR_0201  [0201]
R19642  10K  RESISTOR_0201  [0201]
R19643  10K  RESISTOR_0201  [0201]
R19644  10K  RESISTOR_0201  [0201]
R19645  10K  RESISTOR_0201  [0201]
R19646  10K  RESISTOR_0201  [0201]
R19647  10K  RESISTOR_0201  [0201]
R19648  10K  RESISTOR_0201  [0201]
R19649  10K  RESISTOR_0201  [0201]
R19650  10K  RESISTOR_0201  [0201]
R19651  10K  RESISTOR_0201  [0201]
R19652  10K  RESISTOR_0201  [0201]
R19653  10K  RESISTOR_0201  [0201]
R19654  10K  RESISTOR_0201  [0201]
R19655  10K  RESISTOR_0201  [0201]
R19656  10K  RESISTOR_0201  [0201]
R19657  10K  RESISTOR_0201  [0201]
R19658  10K  RESISTOR_0201  [0201]
R19659  10K  RESISTOR_0201  [0201]
R19660  10K  RESISTOR_0201  [0201]
R19661  10K  RESISTOR_0201  [0201]
R19662  10K  RESISTOR_0201  [0201]
R19663  10K  RESISTOR_0201  [0201]
R19664  10K  RESISTOR_0201  [0201]
R19665  10K  RESISTOR_0201  [0201]
R19666  10K  RESISTOR_0201  [0201]
R19667  10K  RESISTOR_0201  [0201]
R19668  10K  RESISTOR_0201  [0201]
R19669  10K  RESISTOR_0201  [0201]
R19670  10K  RESISTOR_0201  [0201]
R19671  10K  RESISTOR_0201  [0201]
R19672  10K  RESISTOR_0201  [0201]
R19673  10K  RESISTOR_0201  [0201]
R19674  10K  RESISTOR_0201  [0201]
R19675  10K  RESISTOR_0201  [0201]
R19676  10K  RESISTOR_0201  [0201]
R19677  10K  RESISTOR_0201  [0201]
R19678  10K  RESISTOR_0201  [0201]
R19679  10K  RESISTOR_0201  [0201]
R19680  10K  RESISTOR_0201  [0201]
R19681  10K  RESISTOR_0201  [0201]
R19682  10K  RESISTOR_0201  [0201]
R19683  10K  RESISTOR_0201  [0201]
R19684  10K  RESISTOR_0201  [0201]
R19685  10K  RESISTOR_0201  [0201]
R19686  10K  RESISTOR_0201  [0201]
R19687  10K  RESISTOR_0201  [0201]
R19688  10K  RESISTOR_0201  [0201]
R19689  10K  RESISTOR_0201  [0201]
R19690  10K  RESISTOR_0201  [0201]
R19691  10K  RESISTOR_0201  [0201]
R19692  10K  RESISTOR_0201  [0201]
R19693  10K  RESISTOR_0201  [0201]
R19694  10K  RESISTOR_0201  [0201]
R19695  10K  RESISTOR_0201  [0201]
R19696  10K  RESISTOR_0201  [0201]
R19697  10K  RESISTOR_0201  [0201]
R19698  10K  RESISTOR_0201  [0201]
R19699  10K  RESISTOR_0201  [0201]
R19700  10K  RESISTOR_0201  [0201]
R19701  10K  RESISTOR_0201  [0201]
R19702  10K  RESISTOR_0201  [0201]
R19703  10K  RESISTOR_0201  [0201]
R19704  10K  RESISTOR_0201  [0201]
R19705  10K  RESISTOR_0201  [0201]
R19706  10K  RESISTOR_0201  [0201]
R19707  10K  RESISTOR_0201  [0201]
R19708  10K  RESISTOR_0201  [0201]
R19709  10K  RESISTOR_0201  [0201]
R19710  10K  RESISTOR_0201  [0201]
R19711  10K  RESISTOR_0201  [0201]
R19712  10K  RESISTOR_0201  [0201]
R19713  10K  RESISTOR_0201  [0201]
R19714  10K  RESISTOR_0201  [0201]
R19715  10K  RESISTOR_0201  [0201]
R19716  10K  RESISTOR_0201  [0201]
R19717  10K  RESISTOR_0201  [0201]
R19718  10K  RESISTOR_0201  [0201]
R19719  10K  RESISTOR_0201  [0201]
R19720  10K  RESISTOR_0201  [0201]
R19721  10K  RESISTOR_0201  [0201]
R19722  10K  RESISTOR_0201  [0201]
R19723  10K  RESISTOR_0201  [0201]
R19724  10K  RESISTOR_0201  [0201]
R19725  10K  RESISTOR_0201  [0201]
R19726  10K  RESISTOR_0201  [0201]
R19727  10K  RESISTOR_0201  [0201]
R19728  10K  RESISTOR_0201  [0201]
R19729  10K  RESISTOR_0201  [0201]
R19730  10K  RESISTOR_0201  [0201]
R19731  10K  RESISTOR_0201  [0201]
R19732  10K  RESISTOR_0201  [0201]
R19733  10K  RESISTOR_0201  [0201]
R19734  10K  RESISTOR_0201  [0201]
R19735  10K  RESISTOR_0201  [0201]
R19736  10K  RESISTOR_0201  [0201]
R19737  10K  RESISTOR_0201  [0201]
R19738  10K  RESISTOR_0201  [0201]
R19739  10K  RESISTOR_0201  [0201]
R19740  10K  RESISTOR_0201  [0201]
R19741  10K  RESISTOR_0201  [0201]
R19742  10K  RESISTOR_0201  [0201]
R19743  10K  RESISTOR_0201  [0201]
R19744  10K  RESISTOR_0201  [0201]
R19745  10K  RESISTOR_0201  [0201]
R19746  10K  RESISTOR_0201  [0201]
R19747  10K  RESISTOR_0201  [0201]
R19748  10K  RESISTOR_0201  [0201]
R19749  10K  RESISTOR_0201  [0201]
R19750  10K  RESISTOR_0201  [0201]
R19751  10K  RESISTOR_0201  [0201]
R19752  10K  RESISTOR_0201  [0201]
R19753  10K  RESISTOR_0201  [0201]
R19754  10K  RESISTOR_0201  [0201]
R19755  10K  RESISTOR_0201  [0201]
R19756  10K  RESISTOR_0201  [0201]
R19757  10K  RESISTOR_0201  [0201]
R19758  10K  RESISTOR_0201  [0201]
R19759  10K  RESISTOR_0201  [0201]
R19760  10K  RESISTOR_0201  [0201]
R19761  10K  RESISTOR_0201  [0201]
R19762  10K  RESISTOR_0201  [0201]
R19763  10K  RESISTOR_0201  [0201]
R19764  10K  RESISTOR_0201  [0201]
R19765  10K  RESISTOR_0201  [0201]
R19766  10K  RESISTOR_0201  [0201]
R19767  10K  RESISTOR_0201  [0201]
R19768  10K  RESISTOR_0201  [0201]
R19769  10K  RESISTOR_0201  [0201]
R19770  10K  RESISTOR_0201  [0201]
R19771  10K  RESISTOR_0201  [0201]
R19772  10K  RESISTOR_0201  [0201]
R19773  10K  RESISTOR_0201  [0201]
R19774  10K  RESISTOR_0201  [0201]
R19775  10K  RESISTOR_0201  [0201]
R19776  10K  RESISTOR_0201  [0201]
R19777  10K  RESISTOR_0201  [0201]
R19778  10K  RESISTOR_0201  [0201]
R19779  10K  RESISTOR_0201  [0201]
R19780  10K  RESISTOR_0201  [0201]
R19781  10K  RESISTOR_0201  [0201]
R19782  10K  RESISTOR_0201  [0201]
R19783  10K  RESISTOR_0201  [0201]
R19784  10K  RESISTOR_0201  [0201]
R19785  10K  RESISTOR_0201  [0201]
R19786  10K  RESISTOR_0201  [0201]
R19787  10K  RESISTOR_0201  [0201]
R19788  10K  RESISTOR_0201  [0201]
R19789  10K  RESISTOR_0201  [0201]
R19790  10K  RESISTOR_0201  [0201]
R19791  10K  RESISTOR_0201  [0201]
R19792  10K  RESISTOR_0201  [0201]
R19793  10K  RESISTOR_0201  [0201]
R19794  10K  RESISTOR_0201  [0201]
R19795  10K  RESISTOR_0201  [0201]
R19796  10K  RESISTOR_0201  [0201]
R19797  10K  RESISTOR_0201  [0201]
R19798  10K  RESISTOR_0201  [0201]
R19799  10K  RESISTOR_0201  [0201]
R19800  10K  RESISTOR_0201  [0201]
R19801  10K  RESISTOR_0201  [0201]
R19802  10K  RESISTOR_0201  [0201]
R19803  10K  RESISTOR_0201  [0201]
R19804  10K  RESISTOR_0201  [0201]
R19805  10K  RESISTOR_0201  [0201]
R19806  10K  RESISTOR_0201  [0201]
R19807  10K  RESISTOR_0201  [0201]
R19808  10K  RESISTOR_0201  [0201]
R19809  10K  RESISTOR_0201  [0201]
R19810  10K  RESISTOR_0201  [0201]
R19811  10K  RESISTOR_0201  [0201]
R19812  10K  RESISTOR_0201  [0201]
R19813  10K  RESISTOR_0201  [0201]
R19814  10K  RESISTOR_0201  [0201]
R19815  10K  RESISTOR_0201  [0201]
R19816  10K  RESISTOR_0201  [0201]
R19817  10K  RESISTOR_0201  [0201]
R19818  10K  RESISTOR_0201  [0201]
R19819  10K  RESISTOR_0201  [0201]
R19820  10K  RESISTOR_0201  [0201]
R19821  10K  RESISTOR_0201  [0201]
R19822  10K  RESISTOR_0201  [0201]
R19823  10K  RESISTOR_0201  [0201]
R19824  10K  RESISTOR_0201  [0201]
R19825  10K  RESISTOR_0201  [0201]
R19826  10K  RESISTOR_0201  [0201]
R19827  10K  RESISTOR_0201  [0201]
R19828  10K  RESISTOR_0201  [0201]
R19829  10K  RESISTOR_0201  [0201]
R19830  10K  RESISTOR_0201  [0201]
R19831  10K  RESISTOR_0201  [0201]
R19832  10K  RESISTOR_0201  [0201]
R19833  10K  RESISTOR_0201  [0201]
R19834  10K  RESISTOR_0201  [0201]
R19835  10K  RESISTOR_0201  [0201]
R19836  10K  RESISTOR_0201  [0201]
R19837  10K  RESISTOR_0201  [0201]
R19838  10K  RESISTOR_0201  [0201]
R19839  10K  RESISTOR_0201  [0201]
R19840  10K  RESISTOR_0201  [0201]
R19841  10K  RESISTOR_0201  [0201]
R19842  10K  RESISTOR_0201  [0201]
R19843  10K  RESISTOR_0201  [0201]
R19844  10K  RESISTOR_0201  [0201]
R19845  10K  RESISTOR_0201  [0201]
R19846  10K  RESISTOR_0201  [0201]
R19847  10K  RESISTOR_0201  [0201]
R19848  10K  RESISTOR_0201  [0201]
R19849  10K  RESISTOR_0201  [0201]
R19850  10K  RESISTOR_0201  [0201]
R19851  10K  RESISTOR_0201  [0201]
R19852  10K  RESISTOR_0201  [0201]
R19853  10K  RESISTOR_0201  [0201]
R19854  10K  RESISTOR_0201  [0201]
R19855  10K  RESISTOR_0201  [0201]
R19856  10K  RESISTOR_0201  [0201]
R19857  10K  RESISTOR_0201  [0201]
R19858  10K  RESISTOR_0201  [0201]
R19859  10K  RESISTOR_0201  [0201]
R19860  10K  RESISTOR_0201  [0201]
R19861  10K  RESISTOR_0201  [0201]
R19862  10K  RESISTOR_0201  [0201]
R19863  10K  RESISTOR_0201  [0201]
R19864  10K  RESISTOR_0201  [0201]
R19865  10K  RESISTOR_0201  [0201]
R19866  10K  RESISTOR_0201  [0201]
R19867  10K  RESISTOR_0201  [0201]
R19868  10K  RESISTOR_0201  [0201]
R19869  10K  RESISTOR_0201  [0201]
R19870  10K  RESISTOR_0201  [0201]
R19871  10K  RESISTOR_0201  [0201]
R19872  10K  RESISTOR_0201  [0201]
R19873  10K  RESISTOR_0201  [0201]
R19874  10K  RESISTOR_0201  [0201]
R19875  10K  RESISTOR_0201  [0201]
R19876  10K  RESISTOR_0201  [0201]
R19877  10K  RESISTOR_0201  [0201]
R19878  10K  RESISTOR_0201  [0201]
R19879  10K  RESISTOR_0201  [0201]
R19880  10K  RESISTOR_0201  [0201]
R19881  10K  RESISTOR_0201  [0201]
R19882  10K  RESISTOR_0201  [0201]
R19883  10K  RESISTOR_0201  [0201]
R19884  10K  RESISTOR_0201  [0201]
R19885  10K  RESISTOR_0201  [0201]
R19886  10K  RESISTOR_0201  [0201]
R19887  10K  RESISTOR_0201  [0201]
R19888  10K  RESISTOR_0201  [0201]
R19889  10K  RESISTOR_0201  [0201]
R19890  10K  RESISTOR_0201  [0201]
R19891  10K  RESISTOR_0201  [0201]
R19892  10K  RESISTOR_0201  [0201]
R19893  10K  RESISTOR_0201  [0201]
R19894  10K  RESISTOR_0201  [0201]
R19895  10K  RESISTOR_0201  [0201]
R19896  10K  RESISTOR_0201  [0201]
R19897  10K  RESISTOR_0201  [0201]
R19898  10K  RESISTOR_0201  [0201]
R19899  10K  RESISTOR_0201  [0201]
R19900  10K  RESISTOR_0201  [0201]
R19901  10K  RESISTOR_0201  [0201]
R19902  10K  RESISTOR_0201  [0201]
R19903  10K  RESISTOR_0201  [0201]
R19904  10K  RESISTOR_0201  [0201]
R19905  10K  RESISTOR_0201  [0201]
R19906  10K  RESISTOR_0201  [0201]
R19907  10K  RESISTOR_0201  [0201]
R19908  10K  RESISTOR_0201  [0201]
R19909  10K  RESISTOR_0201  [0201]
R19910  10K  RESISTOR_0201  [0201]
R19911  10K  RESISTOR_0201  [0201]
R19912  10K  RESISTOR_0201  [0201]
R19913  10K  RESISTOR_0201  [0201]
R19914  10K  RESISTOR_0201  [0201]
R19915  10K  RESISTOR_0201  [0201]
R19916  10K  RESISTOR_0201  [0201]
R19917  10K  RESISTOR_0201  [0201]
R19918  10K  RESISTOR_0201  [0201]
R19919  10K  RESISTOR_0201  [0201]
R19920  10K  RESISTOR_0201  [0201]
R19921  10K  RESISTOR_0201  [0201]
R19922  10K  RESISTOR_0201  [0201]
R19923  10K  RESISTOR_0201  [0201]
R19924  10K  RESISTOR_0201  [0201]
R19925  10K  RESISTOR_0201  [0201]
R19926  10K  RESISTOR_0201  [0201]
R19927  10K  RESISTOR_0201  [0201]
R19928  10K  RESISTOR_0201  [0201]
R19929  10K  RESISTOR_0201  [0201]
R19930  10K  RESISTOR_0201  [0201]
R19931  10K  RESISTOR_0201  [0201]
R19932  10K  RESISTOR_0201  [0201]
R19933  10K  RESISTOR_0201  [0201]
R19934  10K  RESISTOR_0201  [0201]
R19935  10K  RESISTOR_0201  [0201]
R19936  10K  RESISTOR_0201  [0201]
R19937  10K  RESISTOR_0201  [0201]
R19938  10K  RESISTOR_0201  [0201]
R19939  10K  RESISTOR_0201  [0201]
R19940  10K  RESISTOR_0201  [0201]
R19941  10K  RESISTOR_0201  [0201]
R19942  10K  RESISTOR_0201  [0201]
R19943  10K  RESISTOR_0201  [0201]
R19944  10K  RESISTOR_0201  [0201]
R19945  10K  RESISTOR_0201  [0201]
R19946  10K  RESISTOR_0201  [0201]
R19947  10K  RESISTOR_0201  [0201]
R19948  10K  RESISTOR_0201  [0201]
R19949  10K  RESISTOR_0201  [0201]
R19950  10K  RESISTOR_0201  [0201]
R19951  10K  RESISTOR_0201  [0201]
R19952  10K  RESISTOR_0201  [0201]
R19953  10K  RESISTOR_0201  [0201]
R19954  10K  RESISTOR_0201  [0201]
R19955  10K  RESISTOR_0201  [0201]
R19956  10K  RESISTOR_0201  [0201]
R19957  10K  RESISTOR_0201  [0201]
R19958  10K  RESISTOR_0201  [0201]
R19959  10K  RESISTOR_0201  [0201]
R19960  10K  RESISTOR_0201  [0201]
R19961  10K  RESISTOR_0201  [0201]
R19962  10K  RESISTOR_0201  [0201]
R19963  10K  RESISTOR_0201  [0201]
R19964  10K  RESISTOR_0201  [0201]
R19965  10K  RESISTOR_0201  [0201]
R19966  10K  RESISTOR_0201  [0201]
R19967  10K  RESISTOR_0201  [0201]
R19968  10K  RESISTOR_0201  [0201]
R19969  10K  RESISTOR_0201  [0201]
R19970  10K  RESISTOR_0201  [0201]
R19971  10K  RESISTOR_0201  [0201]
R19972  10K  RESISTOR_0201  [0201]
R19973  10K  RESISTOR_0201  [0201]
R19974  10K  RESISTOR_0201  [0201]
R19975  10K  RESISTOR_0201  [0201]
R19976  10K  RESISTOR_0201  [0201]
R19977  10K  RESISTOR_0201  [0201]
R19978  10K  RESISTOR_0201  [0201]
R19979  10K  RESISTOR_0201  [0201]
R19980  10K  RESISTOR_0201  [0201]
R19981  10K  RESISTOR_0201  [0201]
R19982  10K  RESISTOR_0201  [0201]
R19983  10K  RESISTOR_0201  [0201]
R19984  10K  RESISTOR_0201  [0201]
R19985  10K  RESISTOR_0201  [0201]
R19986  10K  RESISTOR_0201  [0201]
R19987  10K  RESISTOR_0201  [0201]
R19988  10K  RESISTOR_0201  [0201]
R19989  10K  RESISTOR_0201  [0201]
R19990  10K  RESISTOR_0201  [0201]
R19991  10K  RESISTOR_0201  [0201]
R19992  10K  RESISTOR_0201  [0201]
R19993  10K  RESISTOR_0201  [0201]
R19994  10K  RESISTOR_0201  [0201]
R19995  10K  RESISTOR_0201  [0201]
R19996  10K  RESISTOR_0201  [0201]
R19997  10K  RESISTOR_0201  [0201]
R19998  10K  RESISTOR_0201  [0201]
R19999  10K  RESISTOR_0201  [0201]
R20000  10K  RESISTOR_0201  [0201]
R20001  10K  RESISTOR_0201  [0201]
R20002  10K  RESISTOR_0201  [0201]
R20003  10K  RESISTOR_0201  [0201]
R20004  10K  RESISTOR_0201  [0201]
R20005  10K  RESISTOR_0201  [0201]
R20006  10K  RESISTOR_0201  [0201]
R20007  10K  RESISTOR_0201  [0201]
R20008  10K  RESISTOR_0201  [0201]
R20009  10K  RESISTOR_0201  [0201]
R20010  10K  RESISTOR_0201  [0201]
R20011  10K  RESISTOR_0201  [0201]
R20012  10K  RESISTOR_0201  [0201]
R20013  10K  RESISTOR_0201  [0201]
R20014  10K  RESISTOR_0201  [0201]
R20015  10K  RESISTOR_0201  [0201]
R20016  10K  RESISTOR_0201  [0201]
R20017  10K  RESISTOR_0201  [0201]
R20018  10K  RESISTOR_0201  [0201]
R20019  10K  RESISTOR_0201  [0201]
R20020  10K  RESISTOR_0201  [0201]
R20021  10K  RESISTOR_0201  [0201]
R20022  10K  RESISTOR_0201  [0201]
R20023  10K  RESISTOR_0201  [0201]
R20024  10K  RESISTOR_0201  [0201]
R20025  10K  RESISTOR_0201  [0201]
R20026  10K  RESISTOR_0201  [0201]
R20027  10K  RESISTOR_0201  [0201]
R20028  10K  RESISTOR_0201  [0201]
R20029  10K  RESISTOR_0201  [0201]
R20030  10K  RESISTOR_0201  [0201]
R20031  10K  RESISTOR_0201  [0201]
R20032  10K  RESISTOR_0201  [0201]
R20033  10K  RESISTOR_0201  [0201]
R20034  10K  RESISTOR_0201  [0201]
R20035  10K  RESISTOR_0201  [0201]
R20036  10K  RESISTOR_0201  [0201]
R20037  10K  RESISTOR_0201  [0201]
R20038  10K  RESISTOR_0201  [0201]
R20039  10K  RESISTOR_0201  [0201]
R20040  10K  RESISTOR_0201  [0201]
R20041  10K  RESISTOR_0201  [0201]
R20042  10K  RESISTOR_0201  [0201]
R20043  10K  RESISTOR_0201  [0201]
R20044  10K  RESISTOR_0201  [0201]
R20045  10K  RESISTOR_0201  [0201]
R20046  10K  RESISTOR_0201  [0201]
R20047  10K  RESISTOR_0201  [0201]
R20048  10K  RESISTOR_0201  [0201]
R20049  10K  RESISTOR_0201  [0201]
R20050  10K  RESISTOR_0201  [0201]
R20051  10K  RESISTOR_0201  [0201]
R20052  10K  RESISTOR_0201  [0201]
R20053  10K  RESISTOR_0201  [0201]
R20054  10K  RESISTOR_0201  [0201]
R20055  10K  RESISTOR_0201  [0201]
R20056  10K  RESISTOR_0201  [0201]
R20057  10K  RESISTOR_0201  [0201]
R20058  10K  RESISTOR_0201  [0201]
R20059  10K  RESISTOR_0201  [0201]
R20060  10K  RESISTOR_0201  [0201]
R20061  10K  RESISTOR_0201  [0201]
R20062  10K  RESISTOR_0201  [0201]
R20063  10K  RESISTOR_0201  [0201]
R20064  10K  RESISTOR_0201  [0201]
R20065  10K  RESISTOR_0201  [0201]
R20066  10K  RESISTOR_0201  [0201]
R20067  10K  RESISTOR_0201  [0201]
R20068  10K  RESISTOR_0201  [0201]
R20069  10K  RESISTOR_0201  [0201]
R20070  10K  RESISTOR_0201  [0201]
R20071  10K  RESISTOR_0201  [0201]
R20072  10K  RESISTOR_0201  [0201]
R20073  10K  RESISTOR_0201  [0201]
R20074  10K  RESISTOR_0201  [0201]
R20075  10K  RESISTOR_0201  [0201]
R20076  10K  RESISTOR_0201  [0201]
R20077  10K  RESISTOR_0201  [0201]
R20078  10K  RESISTOR_0201  [0201]
R20079  10K  RESISTOR_0201  [0201]
R20080  10K  RESISTOR_0201  [0201]
R20081  10K  RESISTOR_0201  [0201]
R20082  10K  RESISTOR_0201  [0201]
R20083  10K  RESISTOR_0201  [0201]
R20084  10K  RESISTOR_0201  [0201]
R20085  10K  RESISTOR_0201  [0201]
R20086  10K  RESISTOR_0201  [0201]
R20087  10K  RESISTOR_0201  [0201]
R20088  10K  RESISTOR_0201  [0201]
R20089  10K  RESISTOR_0201  [0201]
R20090  10K  RESISTOR_0201  [0201]
R20091  10K  RESISTOR_0201  [0201]
R20092  10K  RESISTOR_0201  [0201]
R20093  10K  RESISTOR_0201  [0201]
R20094  10K  RESISTOR_0201  [0201]
R20095  10K  RESISTOR_0201  [0201]
R20096  10K  RESISTOR_0201  [0201]
R20097  10K  RESISTOR_0201  [0201]
R20098  10K  RESISTOR_0201  [0201]
R20099  10K  RESISTOR_0201  [0201]
R20100  10K  RESISTOR_0201  [0201]
R20101  10K  RESISTOR_0201  [0201]
R20102  10K  RESISTOR_0201  [0201]
R20103  10K  RESISTOR_0201  [0201]
R20104  10K  RESISTOR_0201  [0201]
R20105  10K  RESISTOR_0201  [0201]
R20106  10K  RESISTOR_0201  [0201]
R20107  10K  RESISTOR_0201  [0201]
R20108  10K  RESISTOR_0201  [0201]
R20109  10K  RESISTOR_0201  [0201]
R20110  10K  RESISTOR_0201  [0201]
R20111  10K  RESISTOR_0201  [0201]
R20112  10K  RESISTOR_0201  [0201]
R20113  10K  RESISTOR_0201  [0201]
R20114  10K  RESISTOR_0201  [0201]
R20115  10K  RESISTOR_0201  [0201]
R20116  10K  RESISTOR_0201  [0201]
R20117  10K  RESISTOR_0201  [0201]
R20118  10K  RESISTOR_0201  [0201]
R20119  10K  RESISTOR_0201  [0201]
R20120  10K  RESISTOR_0201  [0201]
R20121  10K  RESISTOR_0201  [0201]
R20122  10K  RESISTOR_0201  [0201]
R20123  10K  RESISTOR_0201  [0201]
R20124  10K  RESISTOR_0201  [0201]
R20125  10K  RESISTOR_0201  [0201]
R20126  10K  RESISTOR_0201  [0201]
R20127  10K  RESISTOR_0201  [0201]
R20128  10K  RESISTOR_0201  [0201]
R20129  10K  RESISTOR_0201  [0201]
R20130  10K  RESISTOR_0201  [0201]
R20131  10K  RESISTOR_0201  [0201]
R20132  10K  RESISTOR_0201  [0201]
R20133  10K  RESISTOR_0201  [0201]
R20134  10K  RESISTOR_0201  [0201]
R20135  10K  RESISTOR_0201  [0201]
R20136  10K  RESISTOR_0201  [0201]
R20137  10K  RESISTOR_0201  [0201]
R20138  10K  RESISTOR_0201  [0201]
R20139  10K  RESISTOR_0201  [0201]
R20140  10K  RESISTOR_0201  [0201]
R20141  10K  RESISTOR_0201  [0201]
R20142  10K  RESISTOR_0201  [0201]
R20143  10K  RESISTOR_0201  [0201]
R20144  10K  RESISTOR_0201  [0201]
R20145  10K  RESISTOR_0201  [0201]
R20146  10K  RESISTOR_0201  [0201]
R20147  10K  RESISTOR_0201  [0201]
R20148  10K  RESISTOR_0201  [0201]
R20149  10K  RESISTOR_0201  [0201]
R20150  10K  RESISTOR_0201  [0201]
R20151  10K  RESISTOR_0201  [0201]
R20152  10K  RESISTOR_0201  [0201]
R20153  10K  RESISTOR_0201  [0201]
R20154  10K  RESISTOR_0201  [0201]
R20155  10K  RESISTOR_0201  [0201]
R20156  10K  RESISTOR_0201  [0201]
R20157  10K  RESISTOR_0201  [0201]
R20158  10K  RESISTOR_0201  [0201]
R20159  10K  RESISTOR_0201  [0201]
R20160  10K  RESISTOR_0201  [0201]
R20161  10K  RESISTOR_0201  [0201]
R20162  10K  RESISTOR_0201  [0201]
R20163  10K  RESISTOR_0201  [0201]
R20164  10K  RESISTOR_0201  [0201]
R20165  10K  RESISTOR_0201  [0201]
R20166  10K  RESISTOR_0201  [0201]
R20167  10K  RESISTOR_0201  [0201]
R20168  10K  RESISTOR_0201  [0201]
R20169  10K  RESISTOR_0201  [0201]
R20170  10K  RESISTOR_0201  [0201]
R20171  10K  RESISTOR_0201  [0201]
R20172  10K  RESISTOR_0201  [0201]
R20173  10K  RESISTOR_0201  [0201]
R20174  10K  RESISTOR_0201  [0201]
R20175  10K  RESISTOR_0201  [0201]
R20176  10K  RESISTOR_0201  [0201]
R20177  10K  RESISTOR_0201  [0201]